# Altium schematic sheet TopSheet.SchDoc
size A1; SheetNumber: 1; SheetTotal: 3
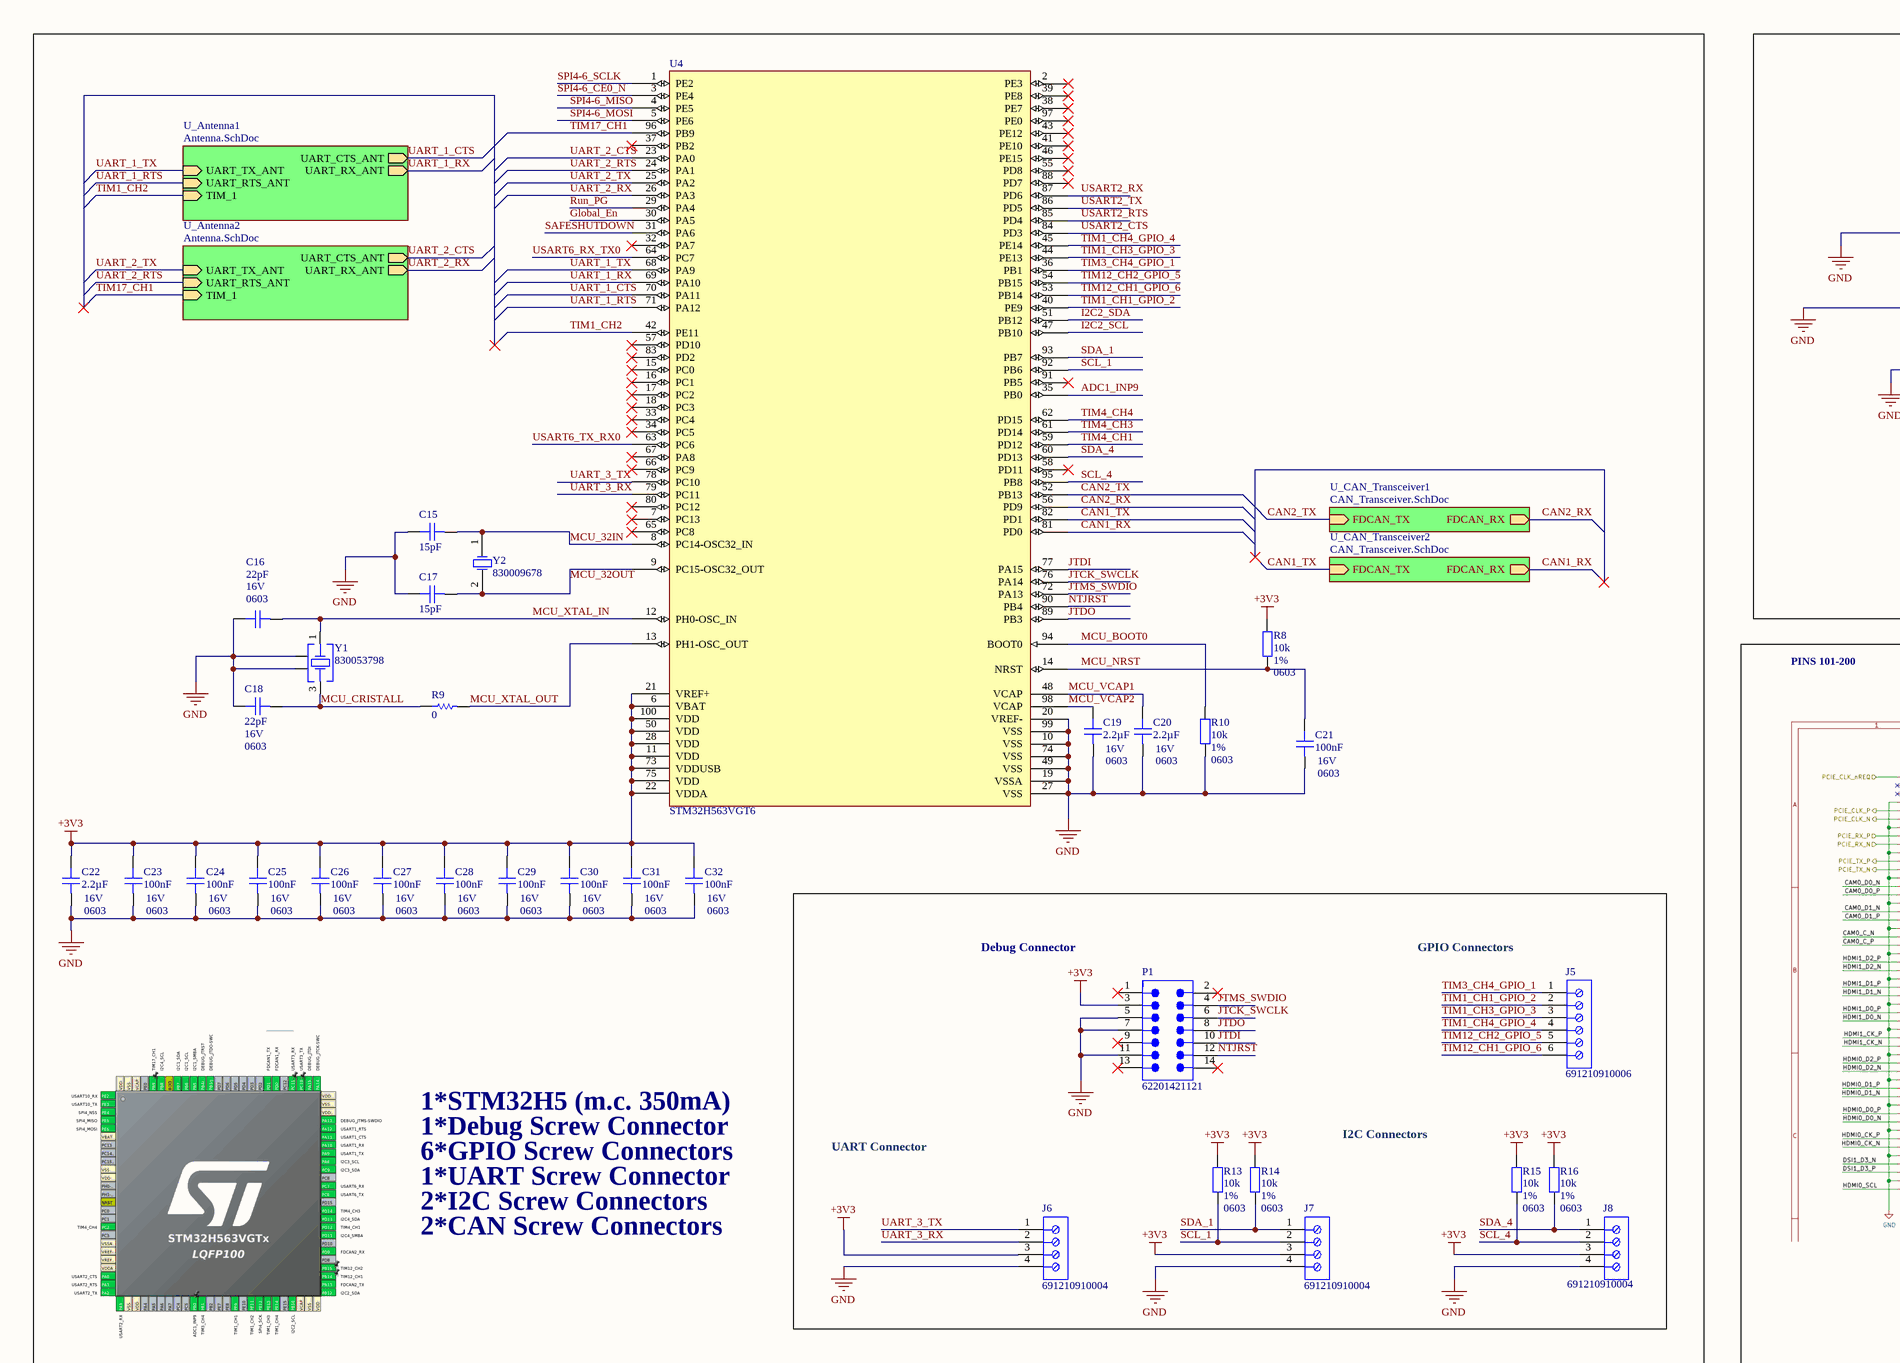
[diagram p0: TopSheet.SchDoc, top left]
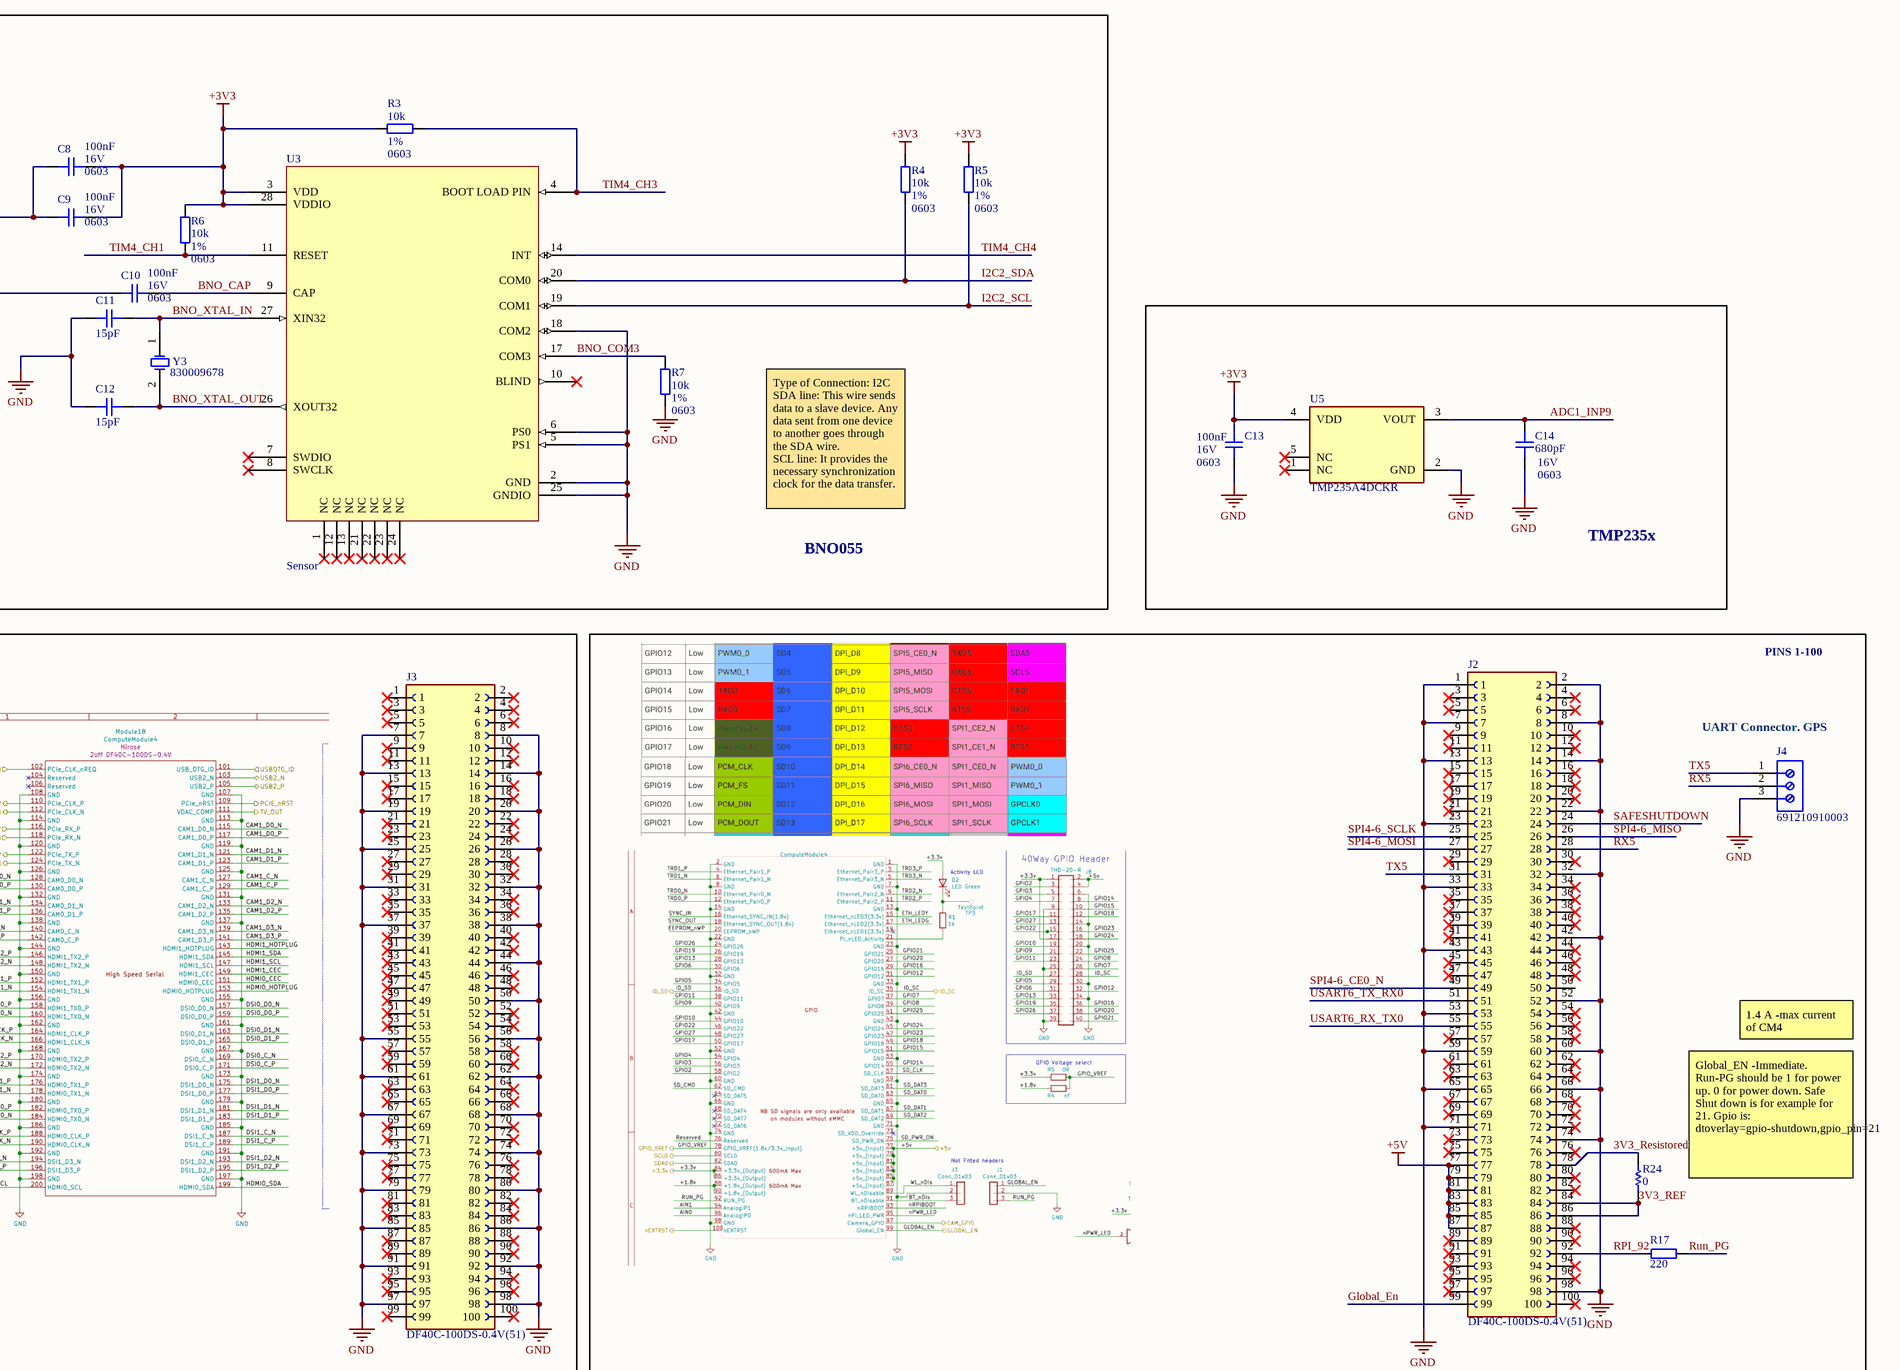
[diagram p1: TopSheet.SchDoc, top right]
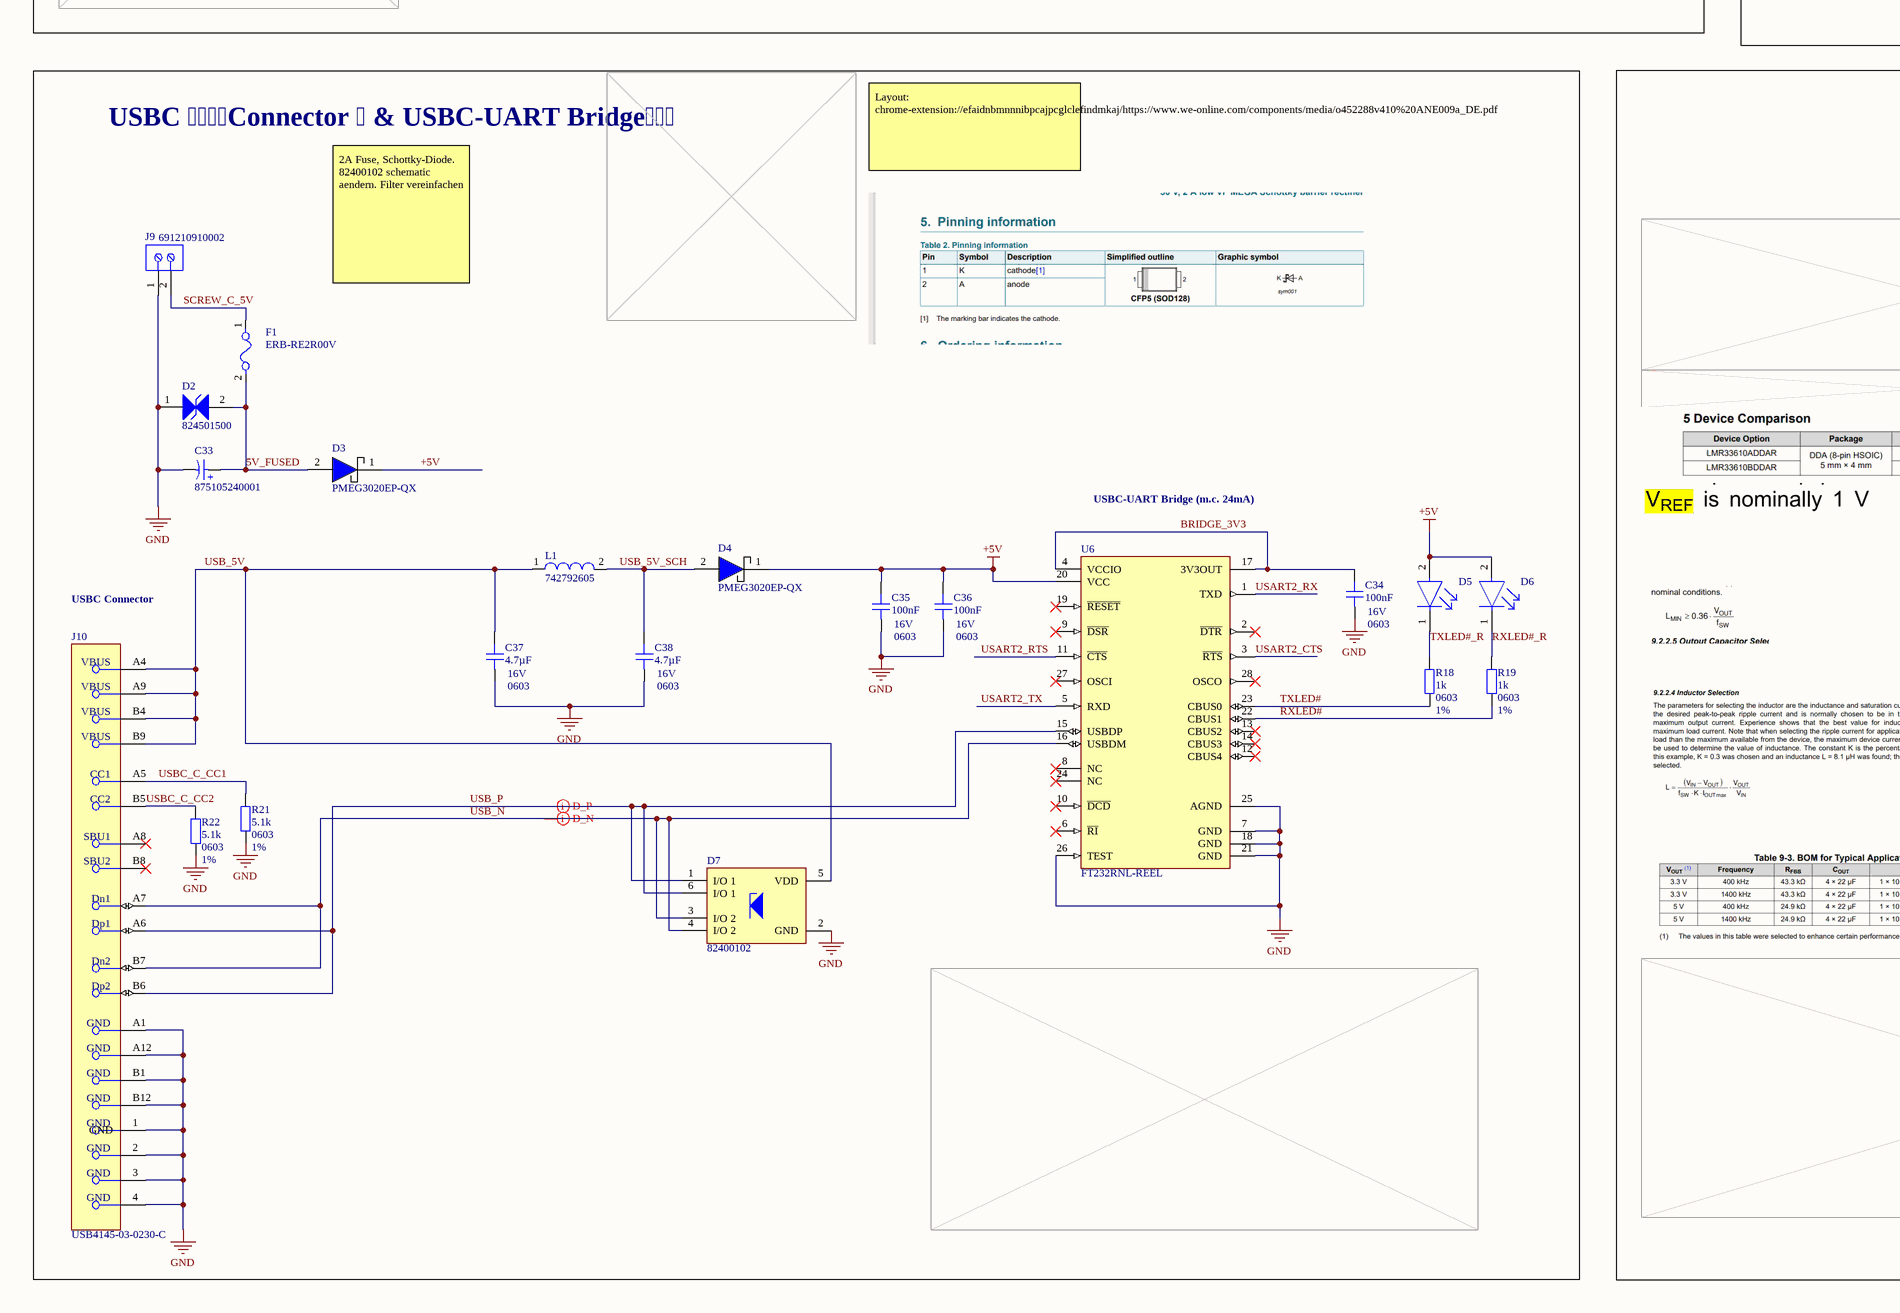
[diagram p2: TopSheet.SchDoc, bottom left]
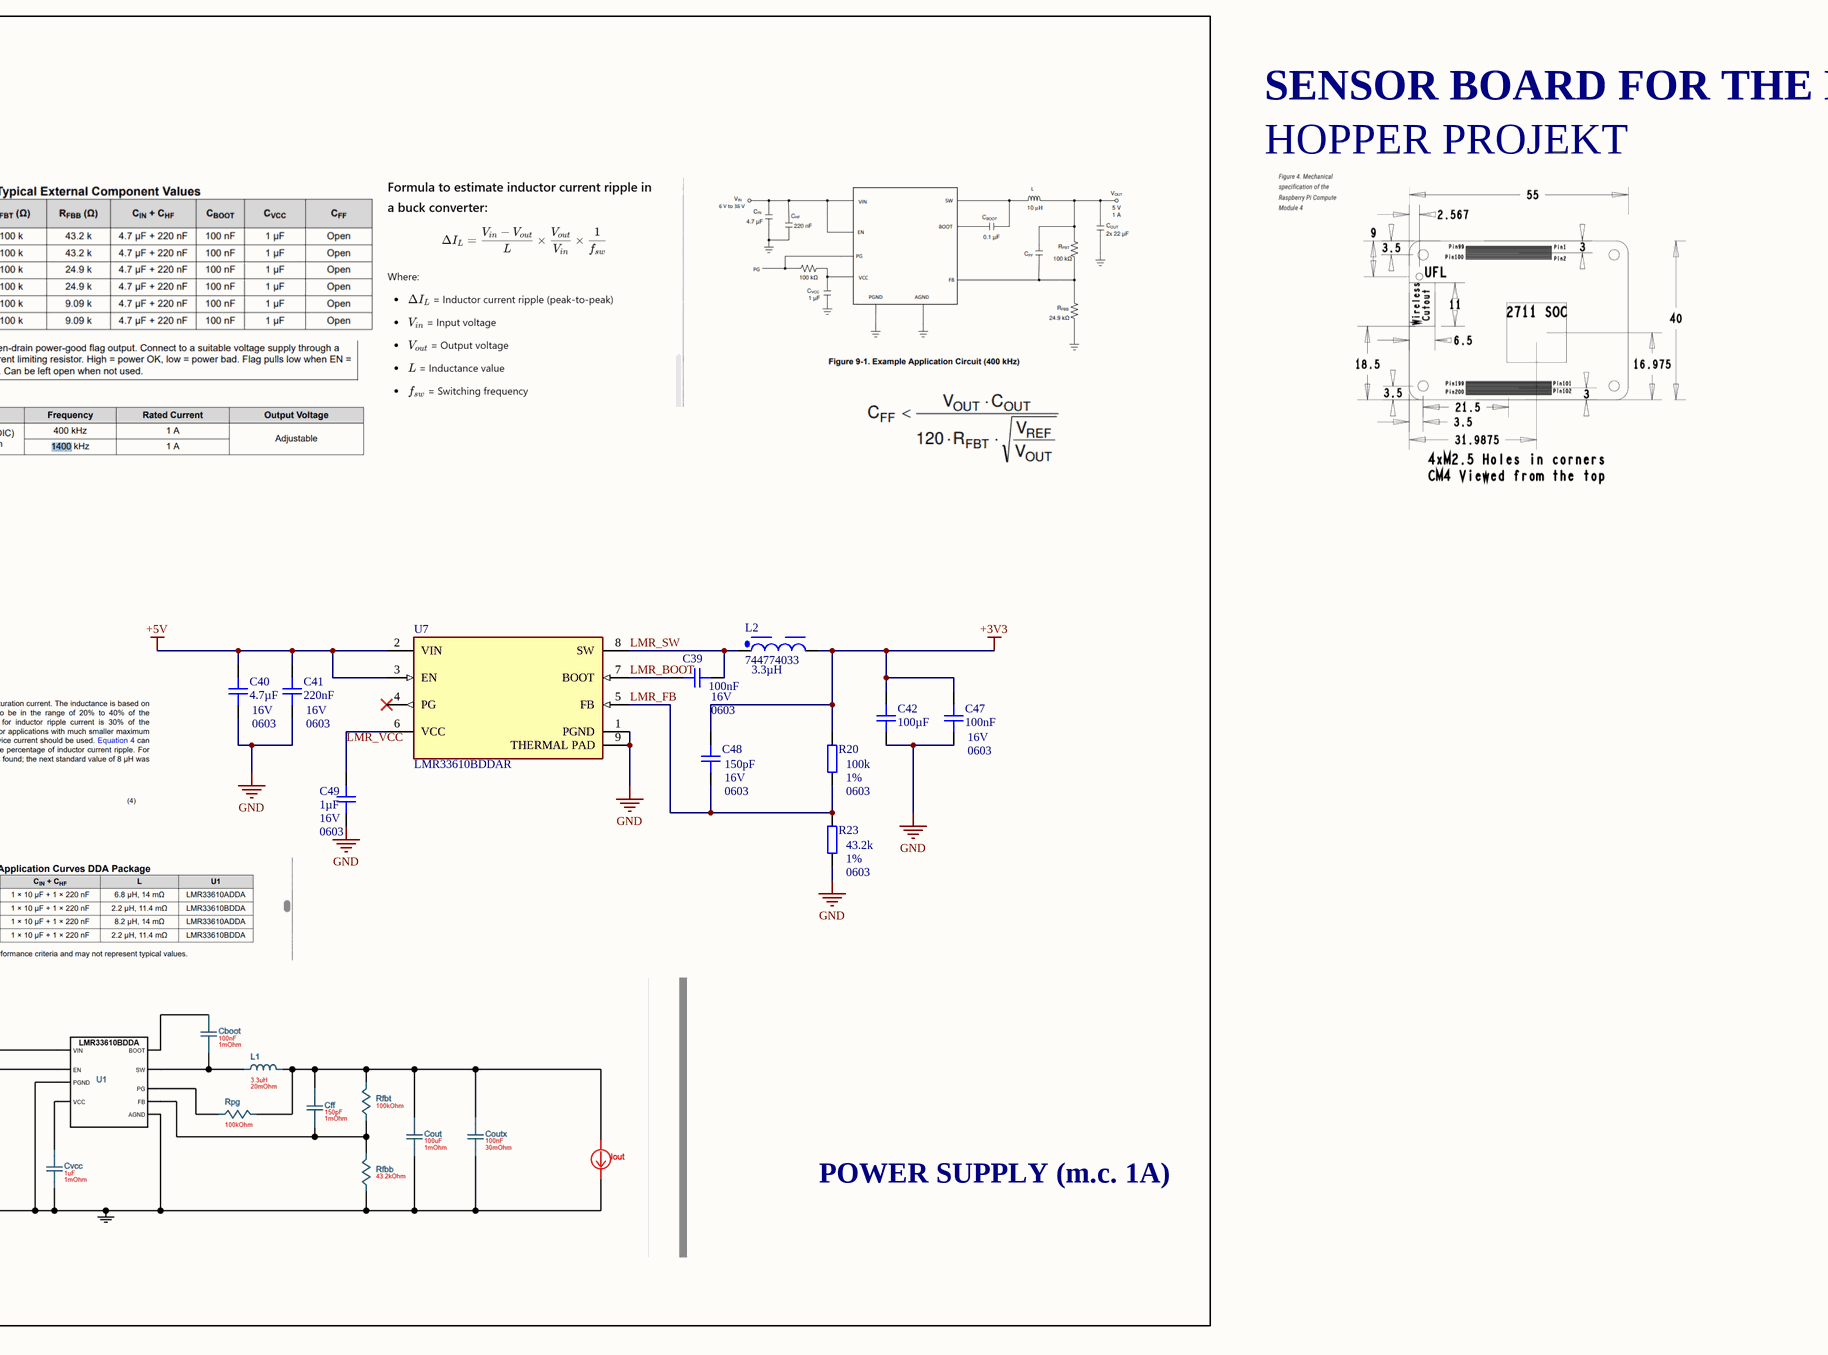
[diagram p3: TopSheet.SchDoc, bottom right]

## Parts
C8  value 100nF  Package / Case: 0603  Voltage - Rated: 16V  [0603_C]  (hidden comment: KGM15AR71C104KT)
C9  value 100nF  Package / Case: 0603  Voltage - Rated: 16V  [0603_C]  (hidden comment: KGM15AR71C104KT)
C10  value 100nF  Package / Case: 0603  Voltage - Rated: 16V  [0603_C]  (hidden comment: KGM15AR71C104KT)
C11  value 15pF  [0603_C]  (hidden comment: KGM15ACG1C150KT)
C12  value 15pF  [0603_C]  (hidden comment: KGM15ACG1C150KT)
C13  value 100nF  Voltage - Rated: 16V  Package / Case: 0603  [0603_C]  (hidden comment: KGM15AR71C104KM)
C14  value 680pF  Voltage - Rated: 16V  Package / Case: 0603  [0603_C]  (hidden comment: KGM15AR71C681KT)
C15  value 15pF  [0603_C]  (hidden comment: KGM15ACG1C150KT)
C16  value 22pF  Voltage - Rated: 16V  Package / Case: 0603  [0603_C]  (hidden comment: KGM15ACG1C220KT)
C17  value 15pF  [0603_C]  (hidden comment: KGM15ACG1C150KT)
C18  value 22pF  Voltage - Rated: 16V  Package / Case: 0603  [0603_C]  (hidden comment: KGM15ACG1C220KT)
C19  value 2.2µF  Voltage - Rated: 16V  Package / Case: 0603  [0603_C]  (hidden comment: KGM15AR51C225KT)
C20  value 2.2µF  Voltage - Rated: 16V  Package / Case: 0603  [0603_C]  (hidden comment: KGM15AR51C225KT)
C21  value 100nF  Voltage - Rated: 16V  Package / Case: 0603  [0603_C]  (hidden comment: KGM15AR71C104KM)
C22  value 2.2µF  Voltage - Rated: 16V  Package / Case: 0603  [0603_C]  (hidden comment: KGM15AR51C225KT)
C23  value 100nF  Voltage - Rated: 16V  Package / Case: 0603  [0603_C]  (hidden comment: KGM15AR71C104KM)
C24  value 100nF  Voltage - Rated: 16V  Package / Case: 0603  [0603_C]  (hidden comment: KGM15AR71C104KM)
C25  value 100nF  Voltage - Rated: 16V  Package / Case: 0603  [0603_C]  (hidden comment: KGM15AR71C104KM)
C26  value 100nF  Voltage - Rated: 16V  Package / Case: 0603  [0603_C]  (hidden comment: KGM15AR71C104KM)
C27  value 100nF  Voltage - Rated: 16V  Package / Case: 0603  [0603_C]  (hidden comment: KGM15AR71C104KM)
C28  value 100nF  Voltage - Rated: 16V  Package / Case: 0603  [0603_C]  (hidden comment: KGM15AR71C104KM)
C29  value 100nF  Voltage - Rated: 16V  Package / Case: 0603  [0603_C]  (hidden comment: KGM15AR71C104KM)
C30  value 100nF  Voltage - Rated: 16V  Package / Case: 0603  [0603_C]  (hidden comment: KGM15AR71C104KM)
C31  value 100nF  Voltage - Rated: 16V  Package / Case: 0603  [0603_C]  (hidden comment: KGM15AR71C104KM)
C32  value 100nF  Voltage - Rated: 16V  Package / Case: 0603  [0603_C]  (hidden comment: KGM15AR71C104KM)
C33  875105240001  [WCAP-PSLP_D4H5.5]
C34  value 100nF  Voltage - Rated: 16V  Package / Case: 0603  [0603_C]  (hidden comment: KGM15AR71C104KM)
C35  value 100nF  Voltage - Rated: 16V  Package / Case: 0603  [0603_C]  (hidden comment: KGM15AR71C104KM)
C36  value 100nF  Voltage - Rated: 16V  Package / Case: 0603  [0603_C]  (hidden comment: KGM15AR71C104KM)
C37  value 4.7µF  Voltage - Rated: 16V  Package / Case: 0603  [0603_C]  (hidden comment: 0603YD475MAT2A)
C38  value 4.7µF  Voltage - Rated: 16V  Package / Case: 0603  [0603_C]  (hidden comment: 0603YD475MAT2A)
C39  value 100nF  Package / Case: 0603  Voltage - Rated: 16V  [0603_C]  (hidden comment: KGM15AR71C104KT)
C40  value 4.7µF  Voltage - Rated: 16V  Package / Case: 0603  [0603_C]  (hidden comment: 0603YD475MAT2A)
C41  value 220nF  Voltage - Rated: 16V  Package / Case: 0603  [0603_C]  (hidden comment: KGM15BR71C224MT)
C42  value 100µF  [1210_C]  (hidden comment: 12106D107MAT2A)
C47  value 100nF  Voltage - Rated: 16V  Package / Case: 0603  [0603_C]  (hidden comment: KGM15AR71C104KM)
C48  value 150pF  Package / Case: 0603  Voltage - Rated: 16V  [0603_C]  (hidden comment: KGM15ACG1C151JT)
C49  value 1µF  Voltage - Rated: 16V  Package / Case: 0603  [0603_C]  (hidden comment: 0603YD105KAT4A)
D2  824501500  [WE-TVSP_DO-214AC_Bidirectional]
D3  PMEG3020EP-QX  [SOD128]
D4  PMEG3020EP-QX  [SOD128]
D5  LTST-C190KGKT  [FP-LTST-C190KGKT-MFG]  (value not drawn)
D6  LTST-C190KRKT  [FP-LTST-C190KRKT-MFG]  (value not drawn)
D7  82400102  [WE-TVS_SOT23-6L]
F1  ERB-RE2R00V  [FP-ERBRE-MFG]
J2  DF40C-100DS-0.4V(51)  [HIROSE_DF40C-100DS-0.4V(51)]
J3  DF40C-100DS-0.4V(51)  [HIROSE_DF40C-100DS-0.4V(51)]
J4  691210910003  [691210910003]
J5  691210910006  [691210910006]
J6  691210910004  [691210910004]
J7  691210910004  [691210910004]
J8  691210910004  [691210910004]
J9  691210910002  [691210910002]
J10  USB4145-03-0230-C  [FP-USB4145-03-0230-C-MFG]
L1  742792605  [SMD-0603]
L2  744774033  Inductance: 3.3µH  [WE-PD2_5848]
P1  62201421121  [62201421121]
R3  value 10k  Tolerance: 1%  Package / Case: 0603  [0603_R]  (hidden comment: RC0603FR-1310KP)
R4  value 10k  Tolerance: 1%  Package / Case: 0603  [0603_R]  (hidden comment: RC0603FR-1310KP)
R5  value 10k  Tolerance: 1%  Package / Case: 0603  [0603_R]  (hidden comment: RC0603FR-1310KP)
R6  value 10k  Tolerance: 1%  Package / Case: 0603  [0603_R]  (hidden comment: RC0603FR-1310KP)
R7  value 10k  Tolerance: 1%  Package / Case: 0603  [0603_R]  (hidden comment: RC0603FR-1310KP)
R8  value 10k  Tolerance: 1%  Package / Case: 0603  [0603_R]  (hidden comment: RC0603FR-1310KP)
R9  value 0  [RESC1608X55X25ML10T15]  (hidden comment: Resistor 0R +/- 5% 0603 100 mW)